# Altium schematic sheet 0018_Processor - CORE P.SchDoc
size A3
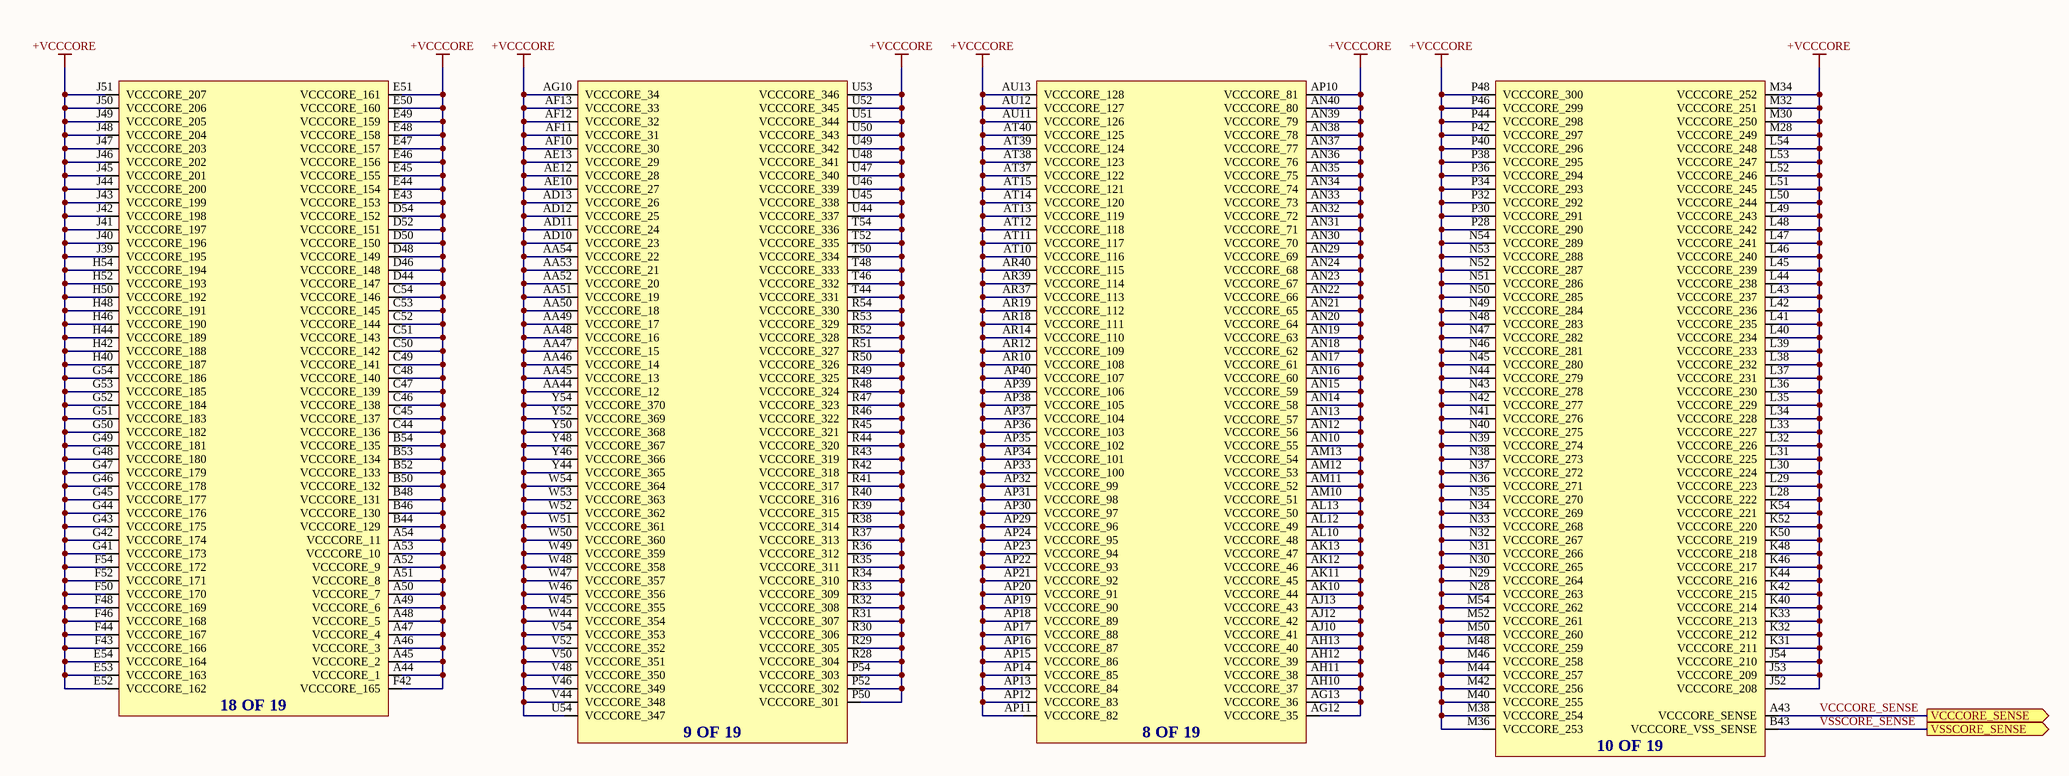
[diagram p0: 0018_Processor - CORE P.SchDoc]

## Parts
U1401  C_RPL_HX_EXT  (value not drawn)  (parts H,I,J,R of 19)

## Ports
VCCCORE_SENSE (out), VSSCORE_SENSE (out)

## Nets
+VCCCORE: U1401.A44(VCCCORE_1) U1401.A45(VCCCORE_2) U1401.A46(VCCCORE_3) U1401.A47(VCCCORE_4) U1401.A48(VCCCORE_5) U1401.A49(VCCCORE_6) U1401.A50(VCCCORE_7) U1401.A51(VCCCORE_8) U1401.A52(VCCCORE_9) U1401.A53(VCCCORE_10) U1401.A54(VCCCORE_11) U1401.AA44(VCCCORE_12) U1401.AA45(VCCCORE_13) U1401.AA46(VCCCORE_14) U1401.AA47(VCCCORE_15) U1401.AA48(VCCCORE_16) U1401.AA49(VCCCORE_17) U1401.AA50(VCCCORE_18) U1401.AA51(VCCCORE_19) U1401.AA52(VCCCORE_20) U1401.AA53(VCCCORE_21) U1401.AA54(VCCCORE_22) U1401.AD10(VCCCORE_23) U1401.AD11(VCCCORE_24) U1401.AD12(VCCCORE_25) U1401.AD13(VCCCORE_26) U1401.AE10(VCCCORE_27) U1401.AE12(VCCCORE_28) U1401.AE13(VCCCORE_29) U1401.AF10(VCCCORE_30) U1401.AF11(VCCCORE_31) U1401.AF12(VCCCORE_32) U1401.AF13(VCCCORE_33) U1401.AG10(VCCCORE_34) U1401.AG12(VCCCORE_35) U1401.AG13(VCCCORE_36) U1401.AH10(VCCCORE_37) U1401.AH11(VCCCORE_38) U1401.AH12(VCCCORE_39) U1401.AH13(VCCCORE_40) U1401.AJ10(VCCCORE_41) U1401.AJ12(VCCCORE_42) U1401.AJ13(VCCCORE_43) U1401.AK10(VCCCORE_44) U1401.AK11(VCCCORE_45) U1401.AK12(VCCCORE_46) U1401.AK13(VCCCORE_47) U1401.AL10(VCCCORE_48) U1401.AL12(VCCCORE_49) U1401.AL13(VCCCORE_50) U1401.AM10(VCCCORE_51) U1401.AM11(VCCCORE_52) U1401.AM12(VCCCORE_53) U1401.AM13(VCCCORE_54) U1401.AN10(VCCCORE_55) U1401.AN12(VCCCORE_56) U1401.AN14(VCCCORE_58) U1401.AN15(VCCCORE_59) U1401.AN16(VCCCORE_60) U1401.AN17(VCCCORE_61) U1401.AN18(VCCCORE_62) U1401.AN19(VCCCORE_63) U1401.AN20(VCCCORE_64) U1401.AN21(VCCCORE_65) U1401.AN22(VCCCORE_66) U1401.AN23(VCCCORE_67) U1401.AN24(VCCCORE_68) U1401.AN29(VCCCORE_69) U1401.AN30(VCCCORE_70) U1401.AN31(VCCCORE_71) U1401.AN32(VCCCORE_72) U1401.AN33(VCCCORE_73) U1401.AN34(VCCCORE_74) U1401.AN35(VCCCORE_75) U1401.AN36(VCCCORE_76) U1401.AN37(VCCCORE_77) U1401.AN38(VCCCORE_78) U1401.AN39(VCCCORE_79) U1401.AN40(VCCCORE_80) U1401.AP10(VCCCORE_81) U1401.AP11(VCCCORE_82) U1401.AP12(VCCCORE_83) U1401.AP13(VCCCORE_84) U1401.AP14(VCCCORE_85) U1401.AP15(VCCCORE_86) U1401.AP16(VCCCORE_87) U1401.AP17(VCCCORE_88) U1401.AP18(VCCCORE_89) U1401.AP19(VCCCORE_90) U1401.AP20(VCCCORE_91) U1401.AP21(VCCCORE_92) U1401.AP22(VCCCORE_93) U1401.AP23(VCCCORE_94) U1401.AP24(VCCCORE_95) U1401.AP29(VCCCORE_96) U1401.AP30(VCCCORE_97) U1401.AP31(VCCCORE_98) U1401.AP32(VCCCORE_99) U1401.AP33(VCCCORE_100) U1401.AP34(VCCCORE_101) U1401.AP35(VCCCORE_102) U1401.AP36(VCCCORE_103) U1401.AP37(VCCCORE_104) U1401.AP38(VCCCORE_105) U1401.AP39(VCCCORE_106) U1401.AP40(VCCCORE_107) U1401.AR10(VCCCORE_108) U1401.AR12(VCCCORE_109) U1401.AR14(VCCCORE_110) U1401.AR18(VCCCORE_111) U1401.AR19(VCCCORE_112) U1401.AR37(VCCCORE_113) U1401.AR39(VCCCORE_114) U1401.AR40(VCCCORE_115) U1401.AT10(VCCCORE_116) U1401.AT11(VCCCORE_117) U1401.AT12(VCCCORE_118) U1401.AT13(VCCCORE_119) U1401.AT14(VCCCORE_120) U1401.AT15(VCCCORE_121) U1401.AT37(VCCCORE_122) U1401.AT38(VCCCORE_123) U1401.AT39(VCCCORE_124) U1401.AT40(VCCCORE_125) U1401.AU11(VCCCORE_126) U1401.AU12(VCCCORE_127) U1401.AU13(VCCCORE_128) U1401.B44(VCCCORE_129) U1401.B46(VCCCORE_130) U1401.B48(VCCCORE_131) U1401.B50(VCCCORE_132) U1401.B52(VCCCORE_133) U1401.B53(VCCCORE_134) U1401.B54(VCCCORE_135) U1401.C44(VCCCORE_136) U1401.C45(VCCCORE_137) U1401.C46(VCCCORE_138) U1401.C47(VCCCORE_139) U1401.C48(VCCCORE_140) U1401.C49(VCCCORE_141) U1401.C50(VCCCORE_142) U1401.C51(VCCCORE_143) U1401.C52(VCCCORE_144) U1401.C53(VCCCORE_145) U1401.C54(VCCCORE_146) U1401.D44(VCCCORE_147) U1401.D46(VCCCORE_148) U1401.D48(VCCCORE_149) U1401.D50(VCCCORE_150) U1401.D52(VCCCORE_151) U1401.D54(VCCCORE_152) U1401.E43(VCCCORE_153) U1401.E44(VCCCORE_154) U1401.E45(VCCCORE_155) U1401.E46(VCCCORE_156) U1401.E47(VCCCORE_157) U1401.E48(VCCCORE_158) U1401.E49(VCCCORE_159) U1401.E50(VCCCORE_160) U1401.E51(VCCCORE_161) U1401.E52(VCCCORE_162) U1401.E53(VCCCORE_163) U1401.E54(VCCCORE_164) U1401.F42(VCCCORE_165) U1401.F43(VCCCORE_166) U1401.F44(VCCCORE_167) U1401.F46(VCCCORE_168) U1401.F48(VCCCORE_169) U1401.F50(VCCCORE_170) U1401.F52(VCCCORE_171) U1401.F54(VCCCORE_172) U1401.G41(VCCCORE_173) U1401.G42(VCCCORE_174) U1401.G43(VCCCORE_175) U1401.G44(VCCCORE_176) U1401.G45(VCCCORE_177) U1401.G46(VCCCORE_178) U1401.G47(VCCCORE_179) U1401.G48(VCCCORE_180) U1401.G49(VCCCORE_181) U1401.G50(VCCCORE_182) U1401.G51(VCCCORE_183) U1401.G52(VCCCORE_184) U1401.G53(VCCCORE_185) U1401.G54(VCCCORE_186) U1401.H40(VCCCORE_187) U1401.H42(VCCCORE_188) U1401.H44(VCCCORE_189) U1401.H46(VCCCORE_190) U1401.H48(VCCCORE_191) U1401.H50(VCCCORE_192) U1401.H52(VCCCORE_193) U1401.H54(VCCCORE_194) U1401.J39(VCCCORE_195) U1401.J40(VCCCORE_196) U1401.J41(VCCCORE_197) U1401.J42(VCCCORE_198) U1401.J43(VCCCORE_199) U1401.J44(VCCCORE_200) U1401.J45(VCCCORE_201) U1401.J46(VCCCORE_202) U1401.J47(VCCCORE_203) U1401.J48(VCCCORE_204) U1401.J49(VCCCORE_205) U1401.J50(VCCCORE_206) U1401.J51(VCCCORE_207) U1401.J52(VCCCORE_208) U1401.J53(VCCCORE_209) U1401.J54(VCCCORE_210) U1401.K31(VCCCORE_211) U1401.K32(VCCCORE_212) U1401.K33(VCCCORE_213) U1401.K40(VCCCORE_214) U1401.K42(VCCCORE_215) U1401.K44(VCCCORE_216) U1401.K46(VCCCORE_217) U1401.K48(VCCCORE_218) U1401.K50(VCCCORE_219) U1401.K52(VCCCORE_220) U1401.K54(VCCCORE_221) U1401.L28(VCCCORE_222) U1401.L29(VCCCORE_223) U1401.L30(VCCCORE_224) U1401.L31(VCCCORE_225) U1401.L32(VCCCORE_226) U1401.L33(VCCCORE_227) U1401.L34(VCCCORE_228) U1401.L35(VCCCORE_229) U1401.L36(VCCCORE_230) U1401.L37(VCCCORE_231) U1401.L38(VCCCORE_232) U1401.L39(VCCCORE_233) U1401.L40(VCCCORE_234) U1401.L41(VCCCORE_235) U1401.L42(VCCCORE_236) U1401.L43(VCCCORE_237) U1401.L44(VCCCORE_238) U1401.L45(VCCCORE_239) U1401.L46(VCCCORE_240) U1401.L47(VCCCORE_241) U1401.L48(VCCCORE_242) U1401.L49(VCCCORE_243) U1401.L50(VCCCORE_244) U1401.L51(VCCCORE_245) U1401.L52(VCCCORE_246) U1401.L53(VCCCORE_247) U1401.L54(VCCCORE_248) U1401.M28(VCCCORE_249) U1401.M30(VCCCORE_250) U1401.M32(VCCCORE_251) U1401.M34(VCCCORE_252) U1401.M36(VCCCORE_253) U1401.M38(VCCCORE_254) U1401.M40(VCCCORE_255) U1401.M42(VCCCORE_256) U1401.M44(VCCCORE_257) U1401.M46(VCCCORE_258) U1401.M48(VCCCORE_259) U1401.M50(VCCCORE_260) U1401.M52(VCCCORE_261) U1401.M54(VCCCORE_262) U1401.N28(VCCCORE_263) U1401.N29(VCCCORE_264) U1401.N30(VCCCORE_265) U1401.N31(VCCCORE_266) U1401.N32(VCCCORE_267) U1401.N33(VCCCORE_268) U1401.N34(VCCCORE_269) U1401.N35(VCCCORE_270) U1401.N36(VCCCORE_271) U1401.N37(VCCCORE_272) U1401.N38(VCCCORE_273) U1401.N39(VCCCORE_274) U1401.N40(VCCCORE_275) U1401.N41(VCCCORE_276) U1401.N42(VCCCORE_277) U1401.N43(VCCCORE_278) U1401.N44(VCCCORE_279) U1401.N45(VCCCORE_280) U1401.N46(VCCCORE_281) U1401.N47(VCCCORE_282) U1401.N48(VCCCORE_283) U1401.N49(VCCCORE_284) U1401.N50(VCCCORE_285) U1401.N51(VCCCORE_286) U1401.N52(VCCCORE_287) U1401.N53(VCCCORE_288) U1401.N54(VCCCORE_289) U1401.P28(VCCCORE_290) U1401.P30(VCCCORE_291) U1401.P32(VCCCORE_292) U1401.P34(VCCCORE_293) U1401.P36(VCCCORE_294) U1401.P38(VCCCORE_295) U1401.P40(VCCCORE_296) U1401.P42(VCCCORE_297) U1401.P44(VCCCORE_298) U1401.P46(VCCCORE_299) U1401.P48(VCCCORE_300) U1401.P50(VCCCORE_301) U1401.P52(VCCCORE_302) U1401.P54(VCCCORE_303) U1401.R28(VCCCORE_304) U1401.R29(VCCCORE_305) U1401.R30(VCCCORE_306) U1401.R31(VCCCORE_307) U1401.R32(VCCCORE_308) U1401.R33(VCCCORE_309) U1401.R34(VCCCORE_310) U1401.R35(VCCCORE_311) U1401.R36(VCCCORE_312) U1401.R37(VCCCORE_313) U1401.R38(VCCCORE_314) U1401.R39(VCCCORE_315) U1401.R40(VCCCORE_316) U1401.R41(VCCCORE_317) U1401.R42(VCCCORE_318) U1401.R43(VCCCORE_319) U1401.R44(VCCCORE_320) U1401.R45(VCCCORE_321) U1401.R46(VCCCORE_322) U1401.R47(VCCCORE_323) U1401.R48(VCCCORE_324) U1401.R49(VCCCORE_325) U1401.R50(VCCCORE_326) U1401.R51(VCCCORE_327) U1401.R52(VCCCORE_328) U1401.R53(VCCCORE_329) U1401.R54(VCCCORE_330) U1401.T44(VCCCORE_331) U1401.T46(VCCCORE_332) U1401.T48(VCCCORE_333) U1401.T50(VCCCORE_334) U1401.T52(VCCCORE_335) U1401.T54(VCCCORE_336) U1401.U44(VCCCORE_337) U1401.U45(VCCCORE_338) U1401.U46(VCCCORE_339) U1401.U47(VCCCORE_340) U1401.U48(VCCCORE_341) U1401.U49(VCCCORE_342) U1401.U50(VCCCORE_343) U1401.U51(VCCCORE_344) U1401.U52(VCCCORE_345) U1401.U53(VCCCORE_346) U1401.U54(VCCCORE_347) U1401.V44(VCCCORE_348) U1401.V46(VCCCORE_349) U1401.V48(VCCCORE_350) U1401.V50(VCCCORE_351) U1401.V52(VCCCORE_352) U1401.V54(VCCCORE_353) U1401.W44(VCCCORE_354) U1401.W45(VCCCORE_355) U1401.W46(VCCCORE_356) U1401.W47(VCCCORE_357) U1401.W48(VCCCORE_358) U1401.W49(VCCCORE_359) U1401.W50(VCCCORE_360) U1401.W51(VCCCORE_361) U1401.W52(VCCCORE_362) U1401.W53(VCCCORE_363) U1401.W54(VCCCORE_364) U1401.Y44(VCCCORE_365) U1401.Y46(VCCCORE_366) U1401.Y48(VCCCORE_367) U1401.Y50(VCCCORE_368) U1401.Y52(VCCCORE_369) U1401.Y54(VCCCORE_370)
VCCCORE_SENSE: U1401.A43(VCCCORE_SENSE) ; port VCCCORE_SENSE
VSSCORE_SENSE: U1401.B43(VCCCORE_VSS_SENSE) ; port VSSCORE_SENSE

Not connected (* = marked no-connect by the designer): U1401 AN13(VCCCORE_57)

## Notes on the sheet
- (in symbol C_RPL_HX_EXT, part H) 8 OF 19
- (in symbol C_RPL_HX_EXT, part I) 9 OF 19
- (in symbol C_RPL_HX_EXT, part J) 10 OF 19
- (in symbol C_RPL_HX_EXT, part R) 18 OF 19